# EasyEDA Pro project ProPrj_Avaota A1 八核 AIoT 开发板_2024-05-20.epro, board 点位_TOP (continued)
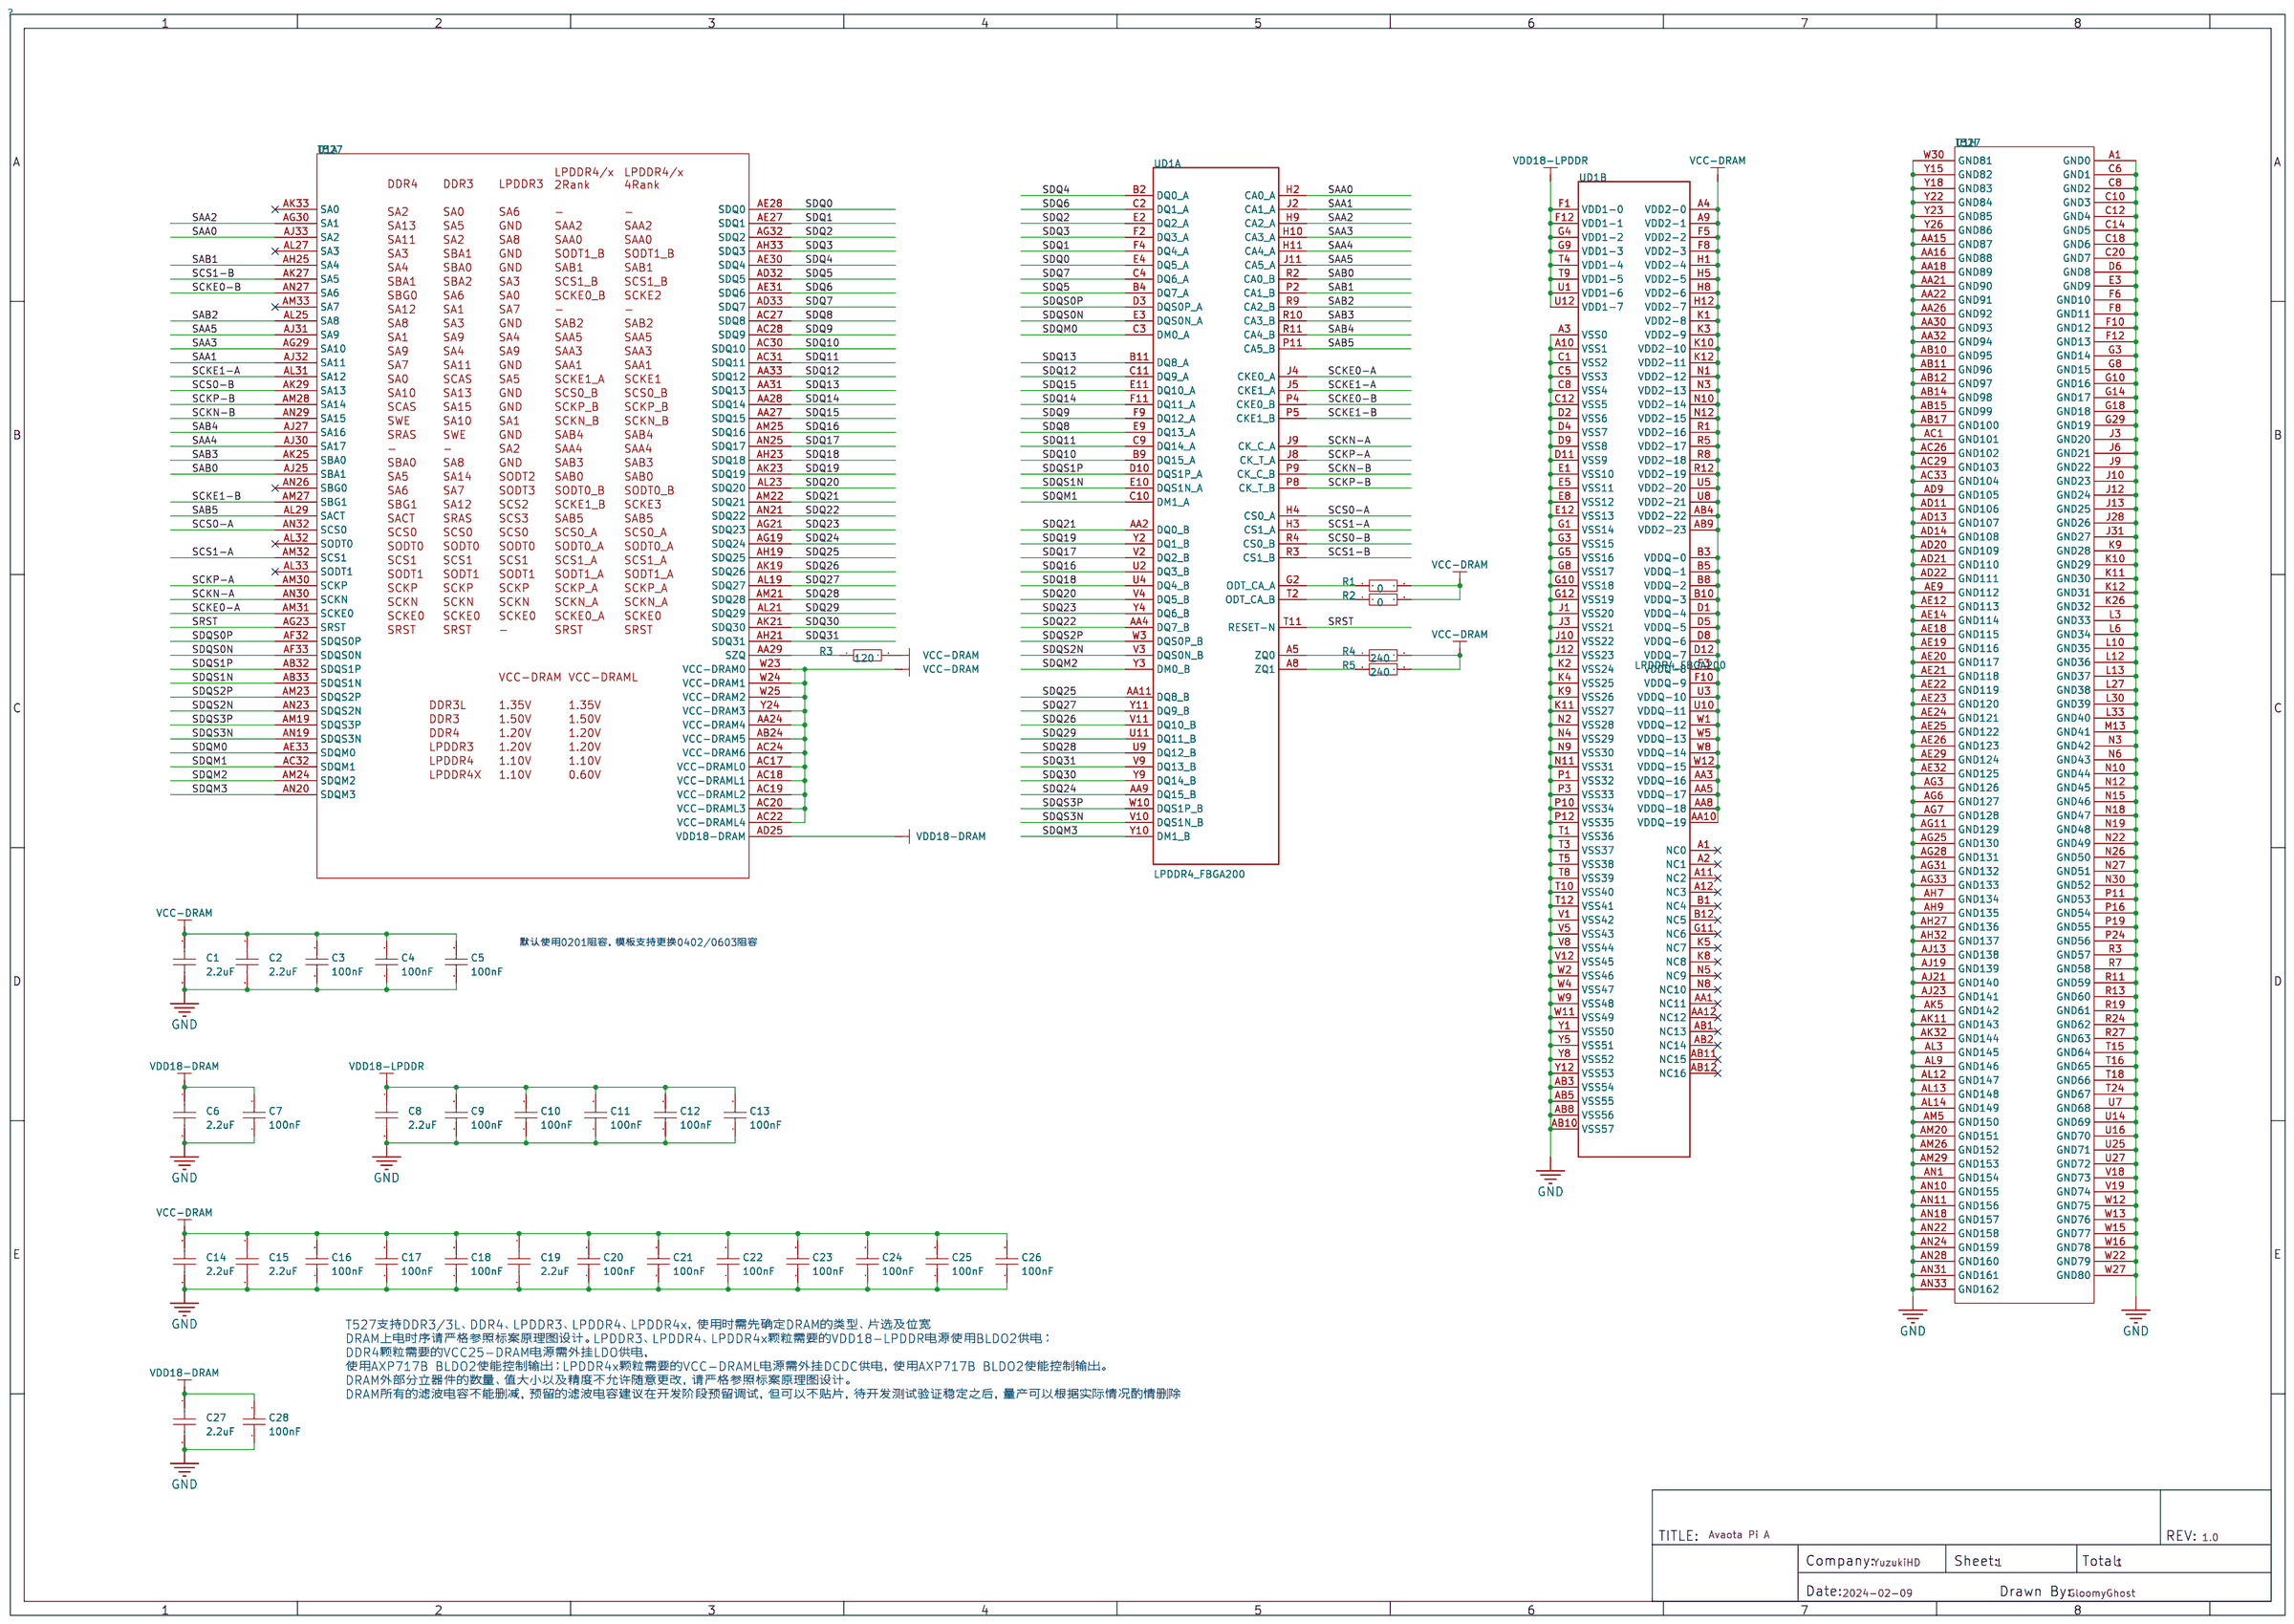
[diagram p0: schematic sheet]
## Routing (per net, layer and track width the routed paths; a pad name or vN(x,y) marks a point on that pad's centre or on a via; arc(x,y) is an arc through that point) (continued)
CTP-RST: length 76
  Top Layer w0.127: v2(62.95,41.65) U14.R30
  内层2 w0.127: v2(24.69,23.27) 25.37,23.27 26.31,24.21 26.31,26.24 26.77,26.7 26.77,32.31 30.61,36.14 36.68,36.14 36.68,36.14 37.62,35.2 38.61,35.2 39.17,34.65 39.17,34.09 39.4,33.86 39.93,33.86 40.59,34.52 41.94,34.52 42.88,33.58 53.06,33.58 55.63,36.14 60.43,36.14 62.51,38.23 62.51,39.17 62.95,39.61 v2(62.95,41.65)
  Bottom Layer w0.127: v2(24.69,23.27) 20.17,23.27 18.49,21.59 7.87,21.59 6.56,20.28 5.51,20.28
CTP-SCK: length 72.5
  Top Layer w0.076: 62.44,40.5 62.44,40.65 ; 62.91,37.53 62.82,37.77 62.63,38.04 62.57,38.33 62.57,39.89 62.69,40 62.69,40.17 62.68,40.26 62.54,40.38 62.44,40.5
  Top Layer w0.102: 62.92,37.53 62.97,37.48 62.97,36.09 v2(63.09,35.97)
  Inner5 w0.127: v2(24.26,22.83) 24.36,22.73 24.84,22.73 25.78,23.67 25.78,29.08 28.73,32.03 42.8,32.03 45.44,34.67 61.06,34.67 62.36,35.97 v2(63.09,35.97)
  Bottom Layer w0.127: v2(24.26,22.83) 20.42,22.83 18.8,21.21 8.08,21.21 6.65,19.78 5.51,19.78
CTP-SDA: length 71.9
  Top Layer w0.076: 62.42,40.12 62.37,39.87 62.38,39.71 62.31,39.51 62.32,39.2 62.31,38.78 62.33,38.32 62.49,37.77
  Top Layer w0.102: 62.48,37.77 62.6,37.63 62.67,37.56 62.67,35.63 v2(62.74,35.56)
  Inner5 w0.127: v2(62.74,35.56) 61.42,34.24 45.59,34.24 42.98,31.62 28.88,31.62 26.14,28.88 26.14,23.44 24.97,22.28 23.93,22.28 v2(23.83,22.38)
  Bottom Layer w0.127: v2(23.83,22.38) 20.65,22.38 19.08,20.8 8.2,20.8 6.68,19.28 5.51,19.28
DCDC1: length 4.6
  Bottom Layer w0.254: 60.89,47.71 60.82,47.65 60.44,47.65 ; 60.44,47.65 v1(60.44,47.15) 60.16,46.86 ; 60.44,47.65 60.44,47.66 60.39,47.72 ; 58.9,47.74 59.4,47.74 59.4,47.73 59.89,47.73 59.94,47.68 v1(59.94,47.15) 60.16,46.93 60.16,46.86 ; 60.16,46.43 60.16,46.36 v1(59.94,46.15) ; 60.16,46.43 v1(60.44,46.15) ; 60.16,46.43 60.16,46.86
  vias: v2(11.89,47.68) v2(11.89,46.96) v2(11.89,46.34) v2(12.4,47.26) v2(12.4,46.66) v2(12.4,46.13)
DCDC2: length 24.5
  Top Layer w0.254: C218.2 8.41,59.08 v2(8.31,58.98) ; U14.P21 62.49,46.15 v1(62.46,46.18) v1(62.46,46.63) ; U14.P21 U14.P22 ; U14.P21 U14.N21 U14.M22 U14.L21 ; U14.P21 62.97,46.17 v1(62.97,46.63) ; U14.R18 U14.R17 62.43,48.15 ; v2(61.95,50.67) 61.47,50.67 U14.U12 U14.U13 U14.T13 61.95,50.14 v2(61.95,49.61) 62.15,49.61 62.44,49.32 U14.R15 62.43,49.14 v1(62.43,48.62) 62.43,48.15 ; v2(61.95,50.67) 61.94,50.68 U14.T11 ; v2(61.95,50.67) 62.43,50.67 v2(62.46,50.65) v2(62.94,50.65) ; 62.43,48.15 62.43,48.16 v1(61.95,48.16) ; v2(62.94,50.65) 62.94,50.15 ; v2(62.94,50.65) U14.N13 ; U14.L18 63.96,48.13 v1(63.96,48.13) ; C210.2 7.87,59.08 v2(7.77,58.98) ; U14.J16 v1(65.86,48.65)
  Bottom Layer w0.152: 66.32,52.15 66.43,52.03 66.43,51.61 ; 66.32,52.15 65.79,52.15 ; 66.32,52.15 66.34,52.17
  Bottom Layer w0.254: 62.97,46.98 v1(62.97,46.63) 62.97,46.16 62.95,46.18 v1(62.46,46.18) v1(62.46,46.63) 62.46,46.95 62.43,46.98 ; v2(62.94,50.65) 62.94,51.13 ; 62.94,51.13 62.94,51.14 ; 62.94,51.13 63.41,51.13 63.42,51.14 ; 61.97,51.14 61.95,51.12 v2(61.95,50.67) ; 65.77,51.6 65.79,51.61 65.79,52.15 ; 65.77,51.6 65.77,49.05 65.86,48.96 v1(65.86,48.65) 65.86,48.58 65.77,48.49 ; 65.77,51.6 66.42,51.6 66.43,51.61 ; 62.45,51.14 62.46,51.13 v2(62.46,50.65) ; v2(61.95,49.61) 62.1,49.61 62.42,49.29 62.42,49.07 62.43,49.06 v1(62.43,48.62)
  vias: v2(6.22,58.29) v2(6.76,58.29) v2(7.77,58.5) v2(8.33,58.5)
DCDC3: length 138.9
  Top Layer w0.115: 44.61,50.01 44.61,49.9 44.62,49.88
  Top Layer w0.203: 43.61,43.51 43.61,44.15 42.98,44.78 42.27,44.78 42.21,44.85
  Top Layer w0.254: 33.41,52 33.27,52 v3(32.97,52.3) 32.87,52.4 32.87,53.12 32.52,53.47 32.23,53.47 32.23,54.1 ; 40.18,43.31 40.18,43.26 40.31,43.26 40.61,43.55 ; 36.61,44.85 36.92,44.85 v3(37.07,44.7) ; 42.21,46.15 42.57,46.15 42.64,46.08 ; 33.01,45.86 v3(33.01,45.14) ; 33.01,45.86 32.66,45.52 32.23,45.52 32.23,44.91 ; 33.01,45.86 v3(33.07,45.92) 33.18,45.92 33.41,46.15 ; v3(33.01,45.14) 33.11,45.14 33.41,44.85 ; v3(33.01,45.14) 33,45.12 ; 39.01,50.7 38.62,50.32 38.5,50.32 38.12,49.94 v3(38.12,49.91) ; v3(38.53,51.46) 39.01,51.94 39.01,52 ; 42.21,49.4 43.61,49.4 v3(43.66,49.45) 43.74,49.53 44.4,49.53 44.68,49.81 44.68,50 44.66,50.01 ; v3(39.87,39.85) 39.85,39.86 39.85,39.95 39.83,39.97 39.83,40.27 39.81,40.3 ; v3(41.48,54.53) 41.02,54.08 41.02,53.85 40.61,53.43 40.61,53.3 ; 42.21,48.1 42.48,48.1 v3(42.57,48.18) ; v3(43.2,52.4) 43.2,52.31 42.9,52 42.21,52 ; 35.81,53.95 35.81,54.4 v3(35.85,54.44) ; 32.23,47.27 32.23,47.85 33.02,47.85 v3(33.14,47.73) 33.41,47.99 33.41,48.1 ; v3(39.39,41.91) 39.34,41.91 39.01,42.25 ; v3(34.86,47.56) 34.86,47.95 35.01,48.1 ; 32.23,49.36 32.23,48.95 v3(32.26,48.92) ; v3(37.11,52.37) 36.98,52.37 36.61,52 ; 39.01,44.85 39.33,44.53 39.37,44.53 39.37,44.52 v3(39.37,44.52) ; v3(37.59,49.91) 37.59,49.65 37.84,49.4 39.01,49.4 ; v2(10.06,54.1) 10.26,54.31 U4.29 ; v3(39.37,40.54) 39.01,40.9 39.01,40.95 ; v3(34.63,41.26) 34.63,41.26 34.94,40.95 35.01,40.95 ; 40.61,40.95 40.99,40.56 v3(40.99,40.56) ; v3(34.67,43.87) 34.99,43.55 35.01,43.55 ; 33.41,42.25 33.23,42.25 v3(32.97,41.99) 32.33,41.99 32.23,41.88 32.23,41.22 ; 36.61,42.25 37.1,42.25 v3(37.18,42.16) ; 36.61,40.95 37.08,40.95 v3(37.16,40.87) ; v3(41,48.39) 40.71,48.1 40.61,48.1 ; v3(44.19,43.74) 43.96,43.51 43.61,43.51 ; v3(38.43,54.58) 38.5,54.51 39.25,54.51 39.81,53.95 ; 36.61,53.3 37.02,53.3 v3(37.06,53.26) 37.56,53.26 v3(37.84,52.98) 37.84,53.42 38.12,53.7 38.67,53.7 39.01,53.36 39.01,53.3 ; v3(38.5,43.74) 38.82,43.74 39.01,43.55 ; 35.01,53.3 35.4,53.7 v3(35.41,53.7) ; 36.61,50.7 37.05,50.25 v3(37.05,49.87) 37.05,49.86 36.61,49.41 36.61,49.4 ; 36.61,43.55 36.97,43.55 v3(37.16,43.74) ; 42.21,42.25 42.53,42.25 v3(42.59,42.19) ; 35.01,50.7 34.81,50.7 v3(34.57,50.94) ; v3(40.99,46) 40.84,46.15 40.61,46.15 ; v3(40.99,50.39) 40.91,50.39 40.61,50.7 ; 35.81,40.3 35.81,39.9 v3(35.68,39.78) 35.12,39.22 32.54,39.22 32.23,39.52 ; v3(35.48,46.63) 35.01,46.16 35.01,46.15 ; v3(33.73,49.07) 33.41,49.4
  内层4 w0.076: v3(37.18,42.16) 37.97,42.29 38.23,42.16 38.23,41.88 38.14,40.95
  内层4 w0.102: v3(37.16,40.87) 37.23,40.95 38.96,40.95 v3(39.37,40.54)
  内层4 w0.254: v3(58.43,48.14) 54.85,48.14 54.46,48.54 52.58,48.54 45.39,55.73 19.68,55.73 16.61,58.8 14.45,58.8 13.74,59.51 11.15,59.51 9.88,58.24 9.88,54.28 v2(10.06,54.1)
  Bottom Layer w0.203: v3(34.86,47.56) 34.67,47.75 34.67,47.98 ; v3(41.48,54.53) 41.42,54.48 41.42,54.31 ; 40.89,47.9 40.89,48.28 v3(41,48.39) ; v3(38.12,49.91) v3(37.59,49.91)
  Bottom Layer w0.254: 36.07,46.76 35.94,46.63 v3(35.48,46.63) ; 40.01,39.27 40.01,39.7 v3(39.87,39.85) ; v3(37.07,44.7) 37.49,44.28 37.49,44.07 v3(37.16,43.74) ; 59.41,43.07 59.41,44.62 v3(59.43,44.64) ; 43.83,44.22 43.83,44.1 v3(44.19,43.74) ; v3(43.2,52.4) 43.17,52.36 43.17,51.87 ; v3(37.05,49.87) 37.58,49.34 37.72,49.34 37.72,49.78 v3(37.59,49.91) ; v3(34.63,41.26) 34.61,41.25 34.39,41.25 33.79,40.66 ; 36.6,42.06 37.08,42.06 v3(37.18,42.16) ; v3(42.59,42.19) 42.59,42.34 42.95,42.7 43.2,42.7 ; v3(37.16,40.87) 37.08,40.95 36.43,40.95 ; 39.8,41.91 v3(39.39,41.91) ; 39.27,39.95 39.27,40.44 v3(39.37,40.54) ; v3(34.57,50.94) 34.62,50.99 35.59,50.99 ; v3(33.73,49.07) 33.6,49.2 32.54,49.2 v3(32.26,48.92) ; 34.75,53.7 v3(35.41,53.7) ; 39.02,54.28 38.73,54.28 v3(38.43,54.58) ; v3(37.11,52.37) 37.06,52.43 v3(37.06,53.26) ; v3(34.67,43.87) 34.16,43.65
  Bottom Layer w0.305: 57.98,45.52 57.98,45.1 v3(58.43,44.64) ; 57.98,45.52 57.96,45.53 57.96,46.63 58.42,46.63 v3(58.43,46.64) ; 57.98,45.52 58.31,45.52 v3(58.43,45.64) ; v3(58.93,44.64) v3(58.43,44.64) ; v3(58.93,44.64) v3(59.43,44.64) v3(59.93,44.64) ; v3(58.93,44.64) 58.93,44.25 58.93,44.25 ; v3(58.43,44.64) 58.43,44.26 58.42,44.25 ; 59.94,44.22 59.94,44.63 v3(59.93,44.64) ; v3(59.93,44.64) v3(60.43,44.64) ; 57.96,47.65 58.43,47.65 v3(58.43,47.64) v3(58.43,48.14) ; v3(60.43,44.64) v3(60.43,44.14) ; v3(60.43,44.64) 60.43,45.13 v3(60.43,45.14) ; 58.43,47.14 57.96,47.14
  vias: v2(11.4,57.96) v2(11.38,57.28) v2(11.86,57.28) v2(11.86,56.72) v2(11.89,57.96) v2(12.37,57.25) v3(40.18,43.31) v3(42.64,46.08) v3(58.43,47.14)
DCIN-5V: length 9.1
  Top Layer w0.254: D3.1 7.74,43.18 9.77,41.15 13.08,41.15 14.22,40.01 R3.2
DCIN-12V: length 7.5
  Top Layer w0.254: R4.2 16.19,27.85 16.03,27.69 14.81,27.69 14.58,27.91 14.58,28.68 14.33,28.93 13.33,28.93 12.9,29.36 12.9,29.54 12.65,29.79 12.65,30.51 12.52,30.63 12.12,30.63 U3.2 11.99,30.28
DCXO-XIN: length 5.7
  Top Layer w0.102: U14.AM13 53.64,50.44 53.21,50.44 53.11,50.34 51.09,50.34 C99.2 50.44,50.36 49.56,50.36 49.02,50.9 X1.1
DCXO-XOUT: length 3.7
  Top Layer w0.102: U14.AN13 51.12,50.15 C98.2 50.35,49.8 X1.3
DDR-PARA-SEL-ADC1: length 4.3
  Top Layer w0.076: 60.44,55.64 60.44,55.79 60.69,56.04 60.69,56.23 60.55,56.42 60.36,56.46 60.18,56.9 60.09,57.34
  Top Layer w0.102: R34.2 R31.1 59.79,58.8 60.1,58.5 60.1,57.35
DDR-PARA-SEL-ADC2: length 6.2
  Top Layer w0.076: 60.44,55.14 60.19,55.39 60.18,55.85 59.82,56.37 59.64,57.21 59.64,57.21
  Top Layer w0.102: 59.64,57.2 59.64,57.21 59.59,57.26 59.59,58.12 59.41,58.29 58.8,58.29 58.55,58.55 57.9,58.55 R35.2 R32.1
DSP-UART-RX: length 19.9
  Bottom Layer w0.102: v1(53.44,55.68) 53.49,55.73 53.49,56.59 53.26,56.82 52.92,56.82 52.4,57.34 52.4,58.09 52.27,58.22 52.27,59.72 54.15,61.6 54.15,69.19 54.91,69.95 54.91,71.86 56.16,73.1 H1.40
DSP-UART-TX: length 17.5
  Top Layer w0.102: U14.AN3 52.93,55.15 52.65,55.42 52.65,56.36 51.94,57.07 v1(51.94,57.76)
  Bottom Layer w0.102: 53.87,64.66 53.87,70.43 53.62,70.69 ; 53.87,64.66 53.87,64.74 ; 53.87,64.66 53.87,61.77 51.94,59.84 v1(51.94,57.76)
EDP-AUXN: length 41.7
  Top Layer w0.076: 68.44,40.14 68.49,40.1 68.49,39.94 69.6,38.83 69.6,38.58 70.05,38.13 70.05,38.1
  Top Layer w0.127: v2(49.66,25.82) 49.56,25.72 49.56,25.44 C199.1 ; 70.05,38.1 73.25,34.9 73.25,34.4 74.24,33.41 74.24,30.96 72.87,29.59 62.64,29.59 59.14,26.09 v2(58.93,26.09)
  内层2 w0.127: v2(58.93,26.09) 58.93,25.88 58.08,25.03 52.29,25.03 52.04,25.27 51.29,25.27 51.16,25.4 51.16,25.68 51.04,25.81 50.91,25.81 50.78,25.68 50.78,25.4 50.66,25.27 50.53,25.27 50.4,25.4 50.4,25.68 50.27,25.81 50.15,25.81 50.02,25.68 50.02,25.4 49.89,25.27 49.58,25.27 49.45,25.4 49.45,25.62 v2(49.66,25.82)
EDP-AUXP: length 41.5
  Top Layer w0.076: 70.22,38.26 69.82,38.65 69.82,38.85 68.68,40 68.68,40.03 68.69,40.04 68.69,40.39 68.44,40.64
  Top Layer w0.127: C198.1 49.23,25.44 49.23,25.72 v2(49.12,25.82) ; 70.22,38.26 73.48,34.99 73.48,34.49 74.47,33.5 74.47,30.87 72.99,29.39 62.76,29.39 59.26,25.88 v2(59.26,25.68)
  内层2 w0.127: v2(49.12,25.82) 49.22,25.72 49.22,25.28 49.51,24.99 52,24.99 52.19,24.8 58.17,24.8 59.08,25.71 59.23,25.71 v2(59.26,25.68)
EDP-HPD: length 41.8
  Top Layer w0.127: 51.09,25.32 51.09,26.23 v2(51.1,26.24) ; 51.09,25.32 R60.2 ; 51.09,25.32 50.95,25.32 50.64,25.01 D12.4 v2(50.64,22.2) ; v2(67.93,42.15) U14.C29
  内层2 w0.127: v2(51.1,26.24) 57.73,32.87 66.32,32.87 66.85,33.4 66.85,34.7 70.51,38.35 70.51,41.25 69.61,42.15 v2(67.93,42.15)
  Bottom Layer w0.127: v2(50.64,22.2) 50.5,22.06 50.5,19.46 50.9,19.05 51.1,19.05 51.56,18.59 51.56,17.93 52.06,17.43 52.39,17.43
EDP-TX0N: length 40.5
  Top Layer w0.076: 72.8,40.64 72.77,40.67 71.83,40.67 70.6,41.89 69.19,41.89 68.94,42.14
  Top Layer w0.127: v2(75.52,32.71) 75.7,32.53 75.7,32.29 75.75,32.25 76.42,32.25 77.44,33.27 77.44,36.14 72.95,40.64 72.8,40.64 ; v2(56.34,25.83) 56.44,25.73 56.44,25.43 C191.1
  内层2 w0.127: v2(56.34,25.83) 56.34,26.07 56.48,26.21 56.48,26.68 59.47,29.67 72.65,29.67 74.29,31.31 74.29,32.56 74.73,32.99 75.11,32.99 75.39,32.71 v2(75.52,32.71)
EDP-TX0P: length 40.4
  Top Layer w0.076: 69.44,42.14 69.51,42.07 70.68,42.07 71.91,40.84 72.77,40.84
  Top Layer w0.127: C190.1 56.74,25.43 56.74,25.71 v2(56.87,25.83) ; v2(75.1,32.34) 75.31,32.13 75.54,32.13 75.65,32.02 76.55,32.02 77.67,33.15 77.67,36.24 73.07,40.84 72.77,40.84
  内层2 w0.127: v2(56.87,25.83) 56.87,26.05 56.71,26.21 56.71,26.58 59.56,29.44 72.75,29.44 74.55,31.24 74.55,32.46 74.83,32.74 75.03,32.74 75.16,32.61 75.16,32.39 v2(75.1,32.34)
EDP-TX1N: length 39.2
  Top Layer w0.076: 70.78,40.83 70.78,40.86 70.23,41.4 69.18,41.4 68.94,41.64
  Top Layer w0.127: C193.1 54.94,25.43 54.94,25.73 v2(54.81,25.86) ; v2(75.29,35.33) 75.5,35.12 75.5,34.93 75.66,34.77 75.84,34.77 76.2,35.13 76.2,36.24 72.38,40.06 71.53,40.06 70.83,40.76
  内层2 w0.127: v2(75.29,35.33) 75.05,35.33 74.01,36.37 71.86,36.37 69.14,33.66 69.14,31.83 67.84,30.53 59.01,30.53 54.98,26.5 54.98,26.24 54.81,26.07 v2(54.81,25.86)
EDP-TX1P: length 39
  Top Layer w0.076: U14.A30 69.48,41.61 70.33,41.61 70.94,40.99
  Top Layer w0.127: v2(55.37,25.83) 55.25,25.71 55.25,25.43 C192.1 ; 70.99,40.92 71.63,40.28 72.54,40.28 76.43,36.4 76.43,35.03 75.92,34.52 75.58,34.52 75.34,34.76 75.14,34.76 v2(74.96,34.95)
  内层2 w0.127: v2(74.96,34.95) 74.96,35.1 73.91,36.14 71.95,36.14 69.37,33.56 69.37,31.7 67.97,30.3 59.11,30.3 55.21,26.41 55.21,26.24 55.37,26.08 v2(55.37,25.83)
EDP-TX2N: length 33.1
  Top Layer w0.076: 70.81,39.95 70.76,39.99 70.76,40.03 69.9,40.89 69.32,40.89 69.07,41.14 68.94,41.14
  Top Layer w0.127: 70.81,39.95 71.31,39.45 72.24,39.45 73.48,38.2 73.48,37.64 73.36,37.52 v1(73.13,37.52) ; C195.1 53.62,25.45 53.62,25.73 v2(53.49,25.86)
  内层2 w0.127: v2(53.49,25.86) 53.49,26.12 53.63,26.26 53.63,26.52 58.53,31.42 67.41,31.42 68.33,32.33 68.33,33.9 71.61,37.19 72.44,37.19 72.64,37.39 73,37.39 v1(73.13,37.52)
EDP-TX2P: length 33.1
  Top Layer w0.076: 69.44,41.14 69.51,41.07 70.02,41.07 70.97,40.13 70.97,40.11
  Top Layer w0.127: 70.97,40.11 71.35,39.73 72.31,39.73 73.74,38.3 73.74,37.57 73.53,37.37 v1(73.53,37.14) ; 53.91,25.86 v2(54,25.86) 53.85,25.71 53.85,25.48 C194.1
  内层2 w0.127: v1(73.53,37.14) 72.77,37.14 72.59,36.96 71.7,36.96 68.55,33.81 68.55,32.23 67.51,31.19 58.62,31.19 53.86,26.43 53.86,26.26 54,26.12 v2(54,25.86)
EDP-TX3N: length 32.1
  Top Layer w0.076: 68.94,40.14 69.01,40.07 69.01,39.97 69.33,39.65 69.58,39.65 69.7,39.52 69.88,39.52 69.98,39.62 70.31,39.62 70.41,39.52 70.41,39.2 70.6,39.01
  Top Layer w0.102: v2(51.99,25.81) 52.12,25.68 52.12,25.45 C197.1
  Top Layer w0.127: 70.6,39.01 70.8,38.81 70.92,38.81 71.04,38.68 71.04,38.51 71.17,38.38 71.3,38.38 71.42,38.51 71.42,38.68 71.55,38.81 71.93,38.81 72.03,38.71 v1(72.03,38.46)
  内层2 w0.127: v2(51.99,25.81) 51.99,26.07 52.15,26.22 52.15,26.38 52.28,26.52 52.28,26.7 52.46,26.88 52.64,26.88 52.82,27.06 52.82,27.24 53,27.42 53.18,27.42 53.36,27.6 53.36,27.78 53.54,27.95 53.72,27.95 53.9,28.13 53.9,28.31 54.08,28.49 54.26,28.49 58.1,32.33 66.93,32.33 67.49,32.89 67.49,34.21 71.53,38.25 71.83,38.25 v1(72.03,38.46)
EDP-TX3P: length 32
  Top Layer w0.076: 68.94,40.64 69.19,40.39 69.19,40.25 69.19,40.25 69.19,40.04 69.4,39.83 70.36,39.83 70.59,39.6 70.59,39.6 70.64,39.55 70.64,39.29 70.76,39.17
  Top Layer w0.102: C196.1 52.4,25.46 52.4,25.68 v2(52.53,25.81)
  Top Layer w0.127: 70.76,39.17 70.92,39.01 72.06,39.01 72.47,38.61 v1(72.47,38.2)
  内层2 w0.127: v1(72.47,38.2) 72.29,38.02 71.63,38.02 67.72,34.11 67.72,32.79 67.03,32.11 58.19,32.11 52.38,26.29 52.38,26.22 52.53,26.07 v2(52.53,25.81)
EMMC-VDDI: length 3.1
  Top Layer w0.102: v2(42.24,36.5) 41.91,36.17 41.91,35.63 U8.C2
  Bottom Layer w0.254: 42.77,36.17 42.77,36.73 ; 42.77,36.73 42.47,36.73 v2(42.24,36.5) ; 42.77,36.73 42.77,37.31
FEL: length 92.5
  Top Layer w0.127: U14.F16 v2(66.94,49.15)
  Top Layer w0.152: R22.2 C96.2 24.15,34.44 23.93,34.66 23.93,37.08 26.57,39.73 26.57,46.05 25.68,46.94 23.85,46.94 22.78,48.01 v1(22.78,50.39)
  内层2 w0.152: v1(22.78,50.39) 19.61,53.57 19.61,58.7 v1(19.08,59.23)
  VCC w0.152: v2(66.94,49.15) 66.67,49.15 65.48,50.34 65.48,51.92 64.41,52.98 64.41,55.09 63.6,55.91 61.7,55.91 60.22,57.38 60.22,60.22 59.64,60.81 58.72,60.81 58.42,60.5 49.89,60.5 47.45,62.94 30.63,62.94 24.77,57.07 22.35,57.07 20.19,59.23 v1(19.08,59.23)
GM0_DVDD10: length 28.4
  Top Layer w0.127: U12.3 65.58,19.91 v2(65.58,19.15) C267.1 ; C266.1 67.6,18.72 v2(67.6,19.18) 67.6,19.93 ; U12.38 63.08,21.43 v2(62.86,21.21) 62.66,21.01 62.66,20.45 62.08,19.86 61.68,19.86 61.58,19.96 ; v2(69.8,26.73) 69.8,26.72 68.4,25.32 U12.21
  Bottom Layer w0.584: 64.11,21.67 63.64,21.21 v2(62.86,21.21) ; 64.11,21.67 64.11,21.41 65.58,19.94 ; 64.11,21.67 64.11,23.85 61.87,26.09 v2(61.87,26.39) v2(61.87,26.95) ; v2(69.8,26.73) 69.8,26.47 68.22,24.89 65.1,24.89 64.16,23.95 ; 65.58,19.94 v2(65.58,19.15) ; 65.58,19.94 66.84,19.94 v2(67.6,19.18)
GM0_INTB: length 2.9
  Top Layer w0.102: U12.31 63.5,24.23 62.99,24.74 62.66,24.74 62.31,25.1 61.58,25.1 61.56,25.12
GM0_LED0: length 2.8
  Top Layer w0.102: 61.56,24.56 62.17,24.56 62.34,24.38 62.81,24.38 63.37,23.83 U12.32
GM0_LED1: length 22.7
  Top Layer w0.102: U12.33 63.13,23.43 v1(62.84,23.72)
  Top Layer w0.152: R94.2 v1(57.99,6.2) R80.2
  内层4 w0.152: v1(57.99,6.2) 57.48,6.7 57.48,19.3 61.14,22.96 62.38,22.96 62.84,23.42 v1(62.84,23.72)
GM0_LED2: length 22.8
  Top Layer w0.127: v1(62.31,23.42) 62.7,23.03 U12.34
  Top Layer w0.152: R79.1 v1(57.4,6.19) R96.2
  内层4 w0.152: v1(62.31,23.42) 62.15,23.27 60.91,23.27 57.12,19.48 57.12,6.47 v1(57.4,6.19)
GM0_MDIN0: length 8.5
  Top Layer w0.127: RJ1.P3 64,14.47 63.81,14.28 63.22,14.28 62.81,14.68 62.81,16.31 65.11,18.61 65.11,19.38 65.2,19.47 U12.2
GM0_MDIN1: length 14.3
  Top Layer w0.127: RJ1.P7 69.08,12.57 68.25,11.74 67.21,11.74 66.55,12.4 66.55,13.49 65.41,14.63 65.41,16.34 66.31,17.25 66.31,19.38 66.4,19.47 U12.5
GM0_MDIN2: length 7.8
  Top Layer w0.127: RJ1.P6 67.37,13.15 67.37,14.09 67.86,14.58 67.86,16.32 67.11,17.06 67.11,19.38 67.2,19.47 U12.7
GM0_MDIN3: length 8.4
  Top Layer w0.127: RJ1.P9 71.62,14.4 71.5,14.28 70.97,14.28 70.38,14.86 70.38,17.25 68.31,19.32 68.31,19.38 68.4,19.47 U12.10
GM0_MDIP0: length 8.5
  Top Layer w0.127: U12.1 64.8,19.47 64.88,19.38 64.88,18.71 62.59,16.41 62.59,14.59 63.06,14.11 63.06,13.23 RJ1.P2
GM0_MDIP1: length 14.3
  Top Layer w0.127: U12.4 66,19.47 66.08,19.38 66.08,17.34 65.18,16.43 65.18,14.54 66.32,13.39 66.32,12.27 67.06,11.53 67.06,10.97 66.57,10.49 65.63,10.49 65.23,10.9 65.23,12.75 RJ1.P4
GM0_MDIP2: length 7.8
  Top Layer w0.127: U12.6 66.8,19.47 66.88,19.38 66.88,16.97 67.63,16.22 67.63,14.67 67.21,14.25 66.85,14.25 66.73,14.38 66.73,15.16 RJ1.P5
GM0_MDIP3: length 8.5
  Top Layer w0.127: RJ1.P8 70.25,13.18 70.82,13.74 70.82,14.1 70.15,14.76 70.15,17.15 68.08,19.22 68.08,19.38 68,19.47 U12.9
GM0_RSET: length 3.5
  Top Layer w0.127: R85.2 61.76,19.56 62.26,19.56 63.02,20.32 63.02,20.82 63.23,21.03 U12.39
GM0_XTAL_IN: length 4.2
  Top Layer w0.127: 60.48,22.4 60.48,22.25 61.06,21.67 61.8,21.67 C252.2 63.3,22.07 63.45,22.23 U12.36
GM0_XTAL_OUT: length 3
  Top Layer w0.127: U12.37 63.59,21.83 63.46,21.7 62.7,21.7 C251.2 61.82,21.21 61.49,20.88
GM1_DVDD10: length 26.2
  Top Layer w0.102: C273.1 80.23,19.91 80.85,19.91 81.15,20.22 81.15,20.7 81.74,21.29 U13.38
  Top Layer w0.127: U13.3 83.77,19.78 v2(83.77,19.13) 83.77,18.72 C275.2 ; U13.8 85.78,19.77 v2(85.78,19.11) C272.1
  Top Layer w0.152: 86.56,24.79 86.56,25.43 87.68,26.56
  Bottom Layer w0.254: v2(86.69,25.5) arc(86.25,25.08) 85.8,24.66
  Bottom Layer w0.635: v2(80.06,26.62) v2(80.06,26.15) 82.45,23.76 ; 82.45,20.45 81.79,20.45 v2(81.31,20.93) ; 82.45,20.45 82.8,20.09 ; 82.45,20.45 82.45,23.76 ; 82.45,23.76 83.35,24.66 85.8,24.66 ; 82.8,20.09 84.8,20.09 v2(85.78,19.11) ; 82.8,20.09 v2(83.77,19.13)
GM1_DVDDRG: length 460.7
  Top Layer w0.102: R106.1 R110.2 79.65,23.99 C271.1 79.13,23.98 v2(78.59,23.98) ; U13.40 81.88,20.49 81.79,20.4 81.79,19.89 81.08,19.18 v2(80.82,19.18) 80.39,18.75 C269.1 ; v2(89.74,21.97) 89.74,21.91 R101.1
  Top Layer w0.127: 61.07,24.66 R88.1 ; 61.07,24.66 R92.2 61.06,24.57 60.98,24.57 ; 61.07,24.66 60.98,24.57 ; v2(71.96,21.9) 71.91,21.84 R83.1 ; C262.1 62.05,18.77 v1(63.37,20.09) 63.37,20.45 63.55,20.63 U12.40 ; C263.1 60.98,24.57 ; R90.1 71.41,20.98 C264.1 69.98,20.45 69.8,20.63 U12.11
  Top Layer w0.152: U13.11 88.28,20.49 v2(88.49,20.27) 88.99,20.27 arc(89.14,20.41) 89.31,20.55 arc(89.44,20.68) R108.1 ; 67.31,27.27 67.34,27.24 ; v1(16.84,57.83) 16.84,55.8 16.1,55.07 16.1,52.11 16.07,52.07 ; v2(62.94,52.58) U14.P9
  Top Layer w0.178: R107.2 85.37,27.33 85.22,27.48 84.51,27.48 84.12,27.86 v1(83.87,27.86) ; R109.2 87.07,27.33 87.38,27.64 88.01,27.64 88.34,27.31 88.34,25.88 88.67,25.55 90.09,25.55 90.53,25.12 90.53,24.28 89.74,23.5 v2(89.74,21.97)
  Top Layer w0.203: U12.28 65.6,25.92 65.63,25.96 v1(65.63,26.71) ; U12.29 65.2,25.91 v2(65.13,25.98) C250.1 ; 83.76,24.79 v2(83.76,25.84) 83.67,25.93 83.67,26.37 83.77,26.47 ; 83.36,24.79 83.36,25.61 83.19,25.78 83.19,26.51 C258.1
  Top Layer w0.254: U14.L17 64.94,48.15 U14.J18 U14.J19 65.44,46.67 v1(65.46,46.66) ; v1(89.99,44.93) 89.26,44.93 88.68,44.36 88.68,40.53 89.48,39.73 90.55,39.73 91.08,39.19 v1(91.08,38.68) v1(91.41,38.36) ; C263.1 60.47,24.56 v2(60.02,24.56) ; 69.01,27.64 69.19,27.46 69.19,27.24 ; R61.1 50.19,25.31 v1(50.19,26.19) ; R125.2 R124.2 94.1,17.59 v2(94.06,17.63) ; v2(4.78,56.72) R14.1 ; v1(67.34,27.69) 67.31,27.66 67.31,27.27 ; U14.K19 64.94,46.67 v1(64.95,46.66)
  Top Layer w0.508: U9.9 v1(16.84,57.83)
  内层2 w0.33: v1(57.44,48.65) 58.64,48.65 58.93,48.36 58.93,46.15 59.46,45.62 60.71,45.62 61.14,45.19 63.32,45.19 64.8,46.66 v1(64.95,46.66) 64.95,48.59 v1(64.44,49.1)
  VCC w0.152: v2(4.78,56.72) 4.7,56.79 3.25,56.79
  VCC w0.254: v1(65.63,26.71) 65.63,25.99 65.63,25.98 ; v1(70.21,20.42) 70.1,20.32 64.47,20.32 64.03,20.75 ; v2(94.06,17.63) 92.66,17.63 90.27,20.02 90.02,20.27 v2(88.49,20.27) ; 50.18,23.44 50.19,23.45 v1(50.19,26.19)
  VCC w0.381: 65.02,41.12 65.43,41.53 65.43,46.63 v1(65.46,46.66) ; v2(62.94,52.58) 62.94,52.2 63.09,52.04 64.24,52.04 v1(64.39,52.2) 64.95,51.64 v1(64.95,46.66) 64.95,44.15 v2(64.44,43.65) 64.44,43.64 64.44,41.45 64.67,41.22
  VCC w0.508: v1(16.84,57.83) 15.88,58.79 15.88,67.84 15.01,68.71 ; 81.52,23.98 81.52,23.99 v2(83.25,25.72) 83.63,25.72 v2(83.76,25.84) 83.69,25.91 83.69,26.97 83.87,27.15 v1(83.87,27.86) ; 52.39,18.73 52.83,19.17 52.83,23.34 52.73,23.44
  VCC w0.762: v2(60.02,24.56) 62.63,24.56 62.69,24.62 ; 62.69,24.62 64.05,25.98 v2(65.13,25.98) 76.66,25.98 78.59,24.05 v2(78.59,23.98) 81.67,23.98 82.32,23.32 82.32,20.68 ; 62.69,24.62 63.03,24.62 64.03,23.62 64.03,20.75 v1(63.37,20.09) ; v1(91.08,38.68) v1(91.41,38.36) 92.53,37.24 92.53,21.79 90.75,20.02 90.27,20.02 87.71,20.09 ; v1(67.34,27.69) v1(69,27.69) 70.47,27.69 70.76,27.39 ; 70.38,26.21 70.76,26.59 70.76,27.39 ; 87.71,20.09 88.5,20.09 ; 87.71,20.09 82.91,20.09 82.32,20.68 ; 82.32,20.68 v2(80.82,19.18) ; 70.76,27.39 70.76,28.55 65.73,33.59 65.73,40.12 64.74,41.1
  VCC w1.27: v2(3.56,53.01) 3.46,53.01 1.57,51.13 1.57,22.58 6.07,18.09 26.43,18.09 32.58,24.23 38.53,24.23 40.11,25.81 46.38,25.81 48.74,23.44 58.9,23.44 v2(60.02,24.56) ; 5.82,68.61 26.14,68.61 28.22,70.69 ; 5.82,68.61 7.9,70.69 ; 5.82,68.61 3.25,66.04 3.25,53.14
  Bottom Layer w0.254: v1(1.96,36.88) 2.05,36.78 5.51,36.78 5.51,36.78 ; RJ2.14 90.84,2.69 ; 90.84,2.69 91.54,2.69 95.35,6.5 95.35,16.33 95.02,16.66 ; 90.84,2.69 80.05,2.69 78.84,1.48 78.55,1.78 74.06,1.78 RJ1.14 72.29,3 62.07,3 RJ1.11 ; 93.34,29.85 92.96,29.46 ; 93.34,29.85 93.46,29.96 94.59,29.96 ; 93.34,29.85 v1(92.74,29.85) ; 92.96,29.46 94.59,29.46 ; 92.96,29.46 92.68,29.18 92.91,28.96 94.59,28.96 ; 89.74,50.53 89.19,50.53 88.72,50.07 88.72,49.84 90.45,48.11 90.45,45.31 90.07,44.93 v1(89.99,44.93) ; 52.4,21.9 52.4,21.05 52.73,20.73 ; v2(64.44,43.65) 64.44,43.21 64.44,43.21 ; 64.44,52.98 64.44,52.25 v1(64.39,52.2) ; 64.92,46.13 64.92,46.63 v1(64.95,46.66) 64.93,46.68 64.93,47.25 ; 52.39,18.73 52.73,19.07 52.73,20.73 ; 52.73,20.73 53.19,21.19 53.19,21.9 ; 95.02,16.66 v2(94.06,17.63) ; 95.02,16.66 98.32,16.66 98.59,16.93 98.83,16.93 98.83,18.32 ; v1(1.93,36.32) 1.98,36.28 5.51,36.28 ; 65.46,46.13 v1(65.46,46.66) 65.46,46.75 65.31,46.89 ; 63.98,48.64 63.98,49.15 64.39,49.15 v1(64.44,49.1)
  Bottom Layer w0.33: 57.96,48.64 57.39,48.64 57.39,48.63
  Bottom Layer w0.381: v2(83.76,25.84) 83.77,25.83 86,25.83 86.28,26.11 86.94,26.11 87.27,25.78 87.27,24.56 88.01,23.83 89.41,23.83 89.89,23.34 89.89,22.12 v2(89.74,21.97)
  Bottom Layer w0.635: 69.93,27.69 70.56,27.05 70.56,26.14 69.16,24.74 69.16,22.5 69.77,21.9 71.91,21.9 ; 69.82,27.71 69.02,27.71 v1(69,27.69)
  vias: v1(92.74,29.24) v2(3.56,53.54) v2(4.09,53.54) v2(4.11,53.04) v2(4.6,53.52)
GM1_INTB: length 2.3
  Top Layer w0.102: 82.26,24.09 81.68,24.09 81.23,24.54 R106.2
GM1_LED0: length 2.2
  Top Layer w0.102: U13.32 81.52,23.69 81.22,23.99 80.16,23.99 R110.1
GM1_LED1: length 25.7
  Top Layer w0.102: 82.26,23.29 v1(81.41,23.29)
  Top Layer w0.152: v2(76.3,8.1) 76.94,7.47 76.94,6.63 76.65,6.34 R112.2 R98.2
  内层2 w0.152: v1(81.41,23.29) 81.41,22.99 80.95,22.53 80.77,22.53 76.71,18.47 76.71,12.24 75.72,11.25 74.32,11.25 73.43,10.36 73.43,8.99 74.68,7.75 75.95,7.75 v2(76.3,8.1)
GM1_LED2: length 24.7
  Top Layer w0.102: v1(80.82,23.04) 81.13,23.04 81.28,22.89 U13.34
  Top Layer w0.152: v2(75.64,7.31) 75.54,7.21 75.54,6.5 75.7,6.34 R114.2 R97.1
  内层2 w0.152: v1(80.82,23.04) 76.35,18.57 76.35,12.42 75.56,11.63 74.24,11.63 73.15,10.54 73.15,8.79 74.52,7.42 75.54,7.42 v2(75.64,7.31)